# Altium schematic sheet BE200.SchDoc (part 2 of 2)
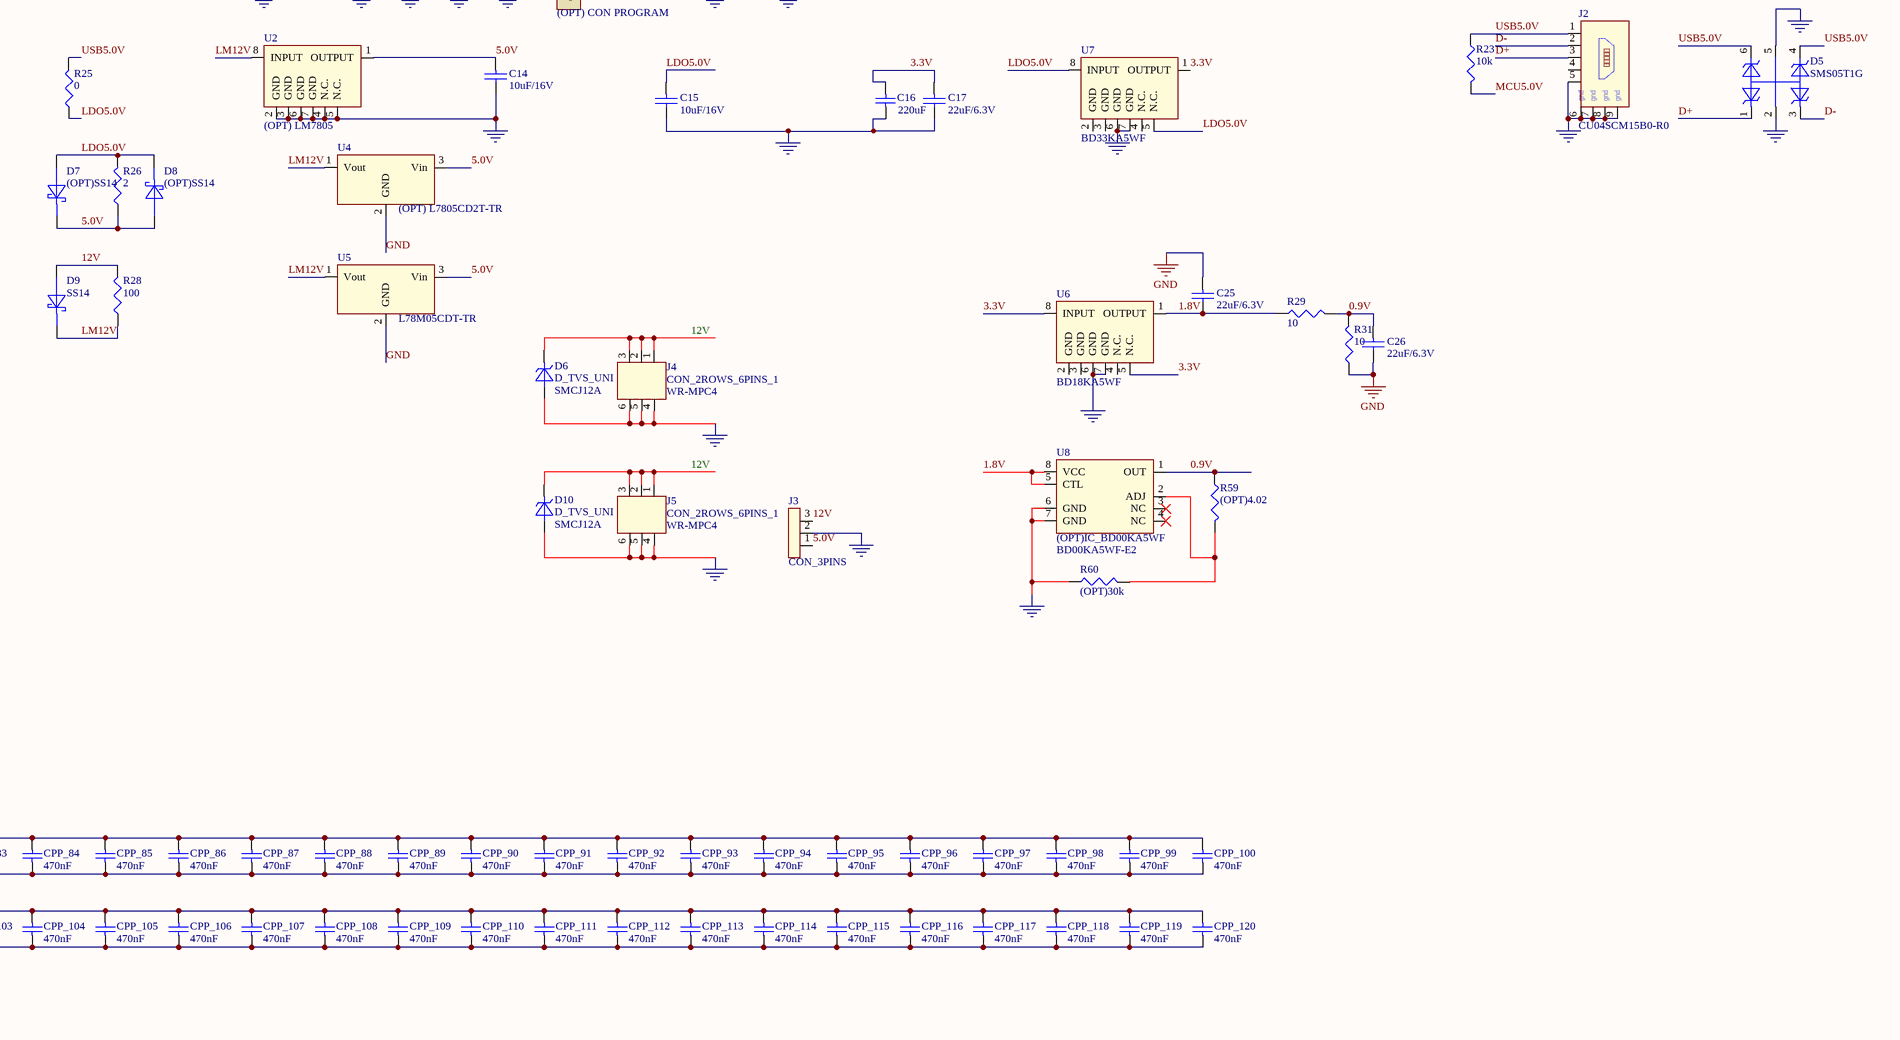
[diagram p6: BE200.SchDoc, bottom right]

## Nets
0.8V: C1_1.2 C1_2.2 C1_3.2 C1_4.2 C1_5.2 C1_6.2 C1_7.2 C1_8.2 C1_9.2 C1_10.2 C1_11.2 C1_12.2 C1_13.2 C1_14.2 C1_15.2 C1_16.2 C2_1.2 C2_2.2 C2_3.2 C2_4.2 C2_5.2 C2_6.2 C2_7.2 C2_8.2 C2_9.2 C2_10.2 C2_11.2 C2_12.2 C2_13.2 C2_14.2 C2_15.2 C2_16.2 C3_1.2 C3_2.2 C3_3.2 C3_4.2 C3_5.2 C3_6.2 C3_7.2 C3_8.2 C3_9.2 C3_10.2 C3_11.2 C3_12.2 C3_13.2 C3_14.2 C3_15.2 C3_16.2 C4_1.2 C4_2.2 C4_3.2 C4_4.2 C4_5.2 C4_6.2 C4_7.2 C4_8.2 C4_9.2 C4_10.2 C4_11.2 C4_12.2 C4_13.2 C4_14.2 C4_15.2 C4_16.2 C5_1.2 C5_2.2 C5_3.2 C5_4.2 C5_5.2 C5_6.2 C5_7.2 C5_8.2 C5_9.2 C5_10.2 C5_11.2 C5_12.2 C5_13.2 C5_14.2 C5_15.2 C5_16.2 C6_1.2 C6_2.2 C6_3.2 C6_4.2 C6_5.2 C6_6.2 C6_7.2 C6_8.2 C6_9.2 C6_10.2 C6_11.2 C6_12.2 C6_13.2 C6_14.2 C6_15.2 C6_16.2 C6P_1.1 C6P_2.1 C6P_3.1 C6P_4.1 C7_1.2 C7_2.2 C7_3.2 C7_4.2 C7_5.2 C7_6.2 C7_7.2 C7_8.2 C7_9.2 C7_10.2 C7_11.2 C7_12.2 C7_13.2 C7_14.2 C7_15.2 C7_16.2 C7P_1.1 C7P_2.1 C7P_3.1 C7P_4.1 C8_1.2 C8_2.2 C8_3.2 C8_4.2 C8_5.2 C8_6.2 C8_7.2 C8_8.2 C8_9.2 C8_10.2 C8_11.2 C8_12.2 C8_13.2 C8_14.2 C8_15.2 C8_16.2 C8P_1.1 C8P_2.1 C8P_3.1 C8P_4.1 C9_1.2 C9_2.2 C9_3.2 C9_4.2 C9_5.2 C9_6.2 C9_7.2 C9_8.2 C9_9.2 C9_10.2 C9_11.2 C9_12.2 C9_13.2 C9_14.2 C9_15.2 C9_16.2 C10_1.2 C10_2.2 C10_3.2 C10_4.2 C10_5.2 C10_6.2 C10_7.2 C10_8.2 C10_9.2 C10_10.2 C10_11.2 C10_12.2 C10_13.2 C10_14.2 C10_15.2 C10_16.2 C11_1.2 C11_2.2 C11_3.2 C11_4.2 C11_5.2 C11_6.2 C11_7.2 C11_8.2 C11_9.2 C11_10.2 C11_11.2 C11_12.2 C11_13.2 C11_14.2 C11_15.2 C11_16.2 C12_1.2 C12_2.2 C12_3.2 C12_4.2 C12_5.2 C12_6.2 C12_7.2 C12_8.2 C12_9.2 C12_10.2 C12_11.2 C12_12.2 C12_13.2 C12_14.2 C12_15.2 C12_16.2 C13_1.2 C13_2.2 C13_3.2 C13_4.2 C13_5.2 C13_6.2 C13_7.2 C13_8.2 C13_9.2 C13_10.2 C13_11.2 C13_12.2 C13_13.2 C13_14.2 C13_15.2 C13_16.2 C14_1.2 C14_2.2 C14_3.2 C14_4.2 C14_5.2 C14_6.2 C14_7.2 C14_8.2 C14_9.2 C14_10.2 C14_11.2 C14_12.2 C14_13.2 C14_14.2 C14_15.2 C14_16.2 C15_1.2 C15_2.2 C15_3.2 C15_4.2 C15_5.2 C15_6.2 C15_7.2 C15_8.2 C15_9.2 C15_10.2 C15_11.2 C15_12.2 C15_13.2 C15_14.2 C15_15.2 C15_16.2 C16_1.2 C16_2.2 C16_3.2 C16_4.2 C16_5.2 C16_6.2 C16_7.2 C16_8.2 C16_9.2 C16_10.2 C16_11.2 C16_12.2 C16_13.2 C16_14.2 C16_15.2 C16_16.2 CPP_1.2 CPP_2.2 CPP_3.2 CPP_4.2 CPP_5.2 CPP_6.2 CPP_7.2 CPP_8.2 CPP_9.2 CPP_10.2 CPP_11.2 CPP_12.2 CPP_13.2 CPP_14.2 CPP_15.2 CPP_16.2 CPP_17.2 CPP_18.2 CPP_19.2 CPP_20.2 CPP_21.2 CPP_22.2 CPP_23.2 CPP_24.2 CPP_25.2 CPP_26.2 CPP_27.2 CPP_28.2 CPP_29.2 CPP_30.2 CPP_31.2 CPP_32.2 CPP_33.2 CPP_34.2 CPP_35.2 CPP_36.2 CPP_37.2 CPP_38.2 CPP_39.2 CPP_40.2 CPP_41.2 CPP_42.2 CPP_43.2 CPP_44.2 CPP_45.2 CPP_46.2 CPP_47.2 CPP_48.2 CPP_49.2 CPP_50.2 CPP_51.2 CPP_52.2 CPP_53.2 CPP_54.2 CPP_55.2 CPP_56.2 CPP_57.2 CPP_58.2 CPP_59.2 CPP_60.2 CPP_61.2 CPP_62.2 CPP_63.2 CPP_64.2 CPP_65.2 CPP_66.2 CPP_67.2 CPP_68.2 CPP_69.2 CPP_70.2 CPP_71.2 CPP_72.2 CPP_73.2 CPP_74.2 CPP_75.2 CPP_76.2 CPP_77.2 CPP_78.2 CPP_79.2 CPP_80.2 CPP_81.2 CPP_82.2 CPP_83.2 CPP_84.2 CPP_85.2 CPP_86.2 CPP_87.2 CPP_88.2 CPP_89.2 CPP_90.2 CPP_91.2 CPP_92.2 CPP_93.2 CPP_94.2 CPP_95.2 CPP_96.2 CPP_97.2 CPP_98.2 CPP_99.2 CPP_100.2 CPP_101.2 CPP_102.2 CPP_103.2 CPP_104.2 CPP_105.2 CPP_106.2 CPP_107.2 CPP_108.2 CPP_109.2 CPP_110.2 CPP_111.2 CPP_112.2 CPP_113.2 CPP_114.2 CPP_115.2 CPP_116.2 CPP_117.2 CPP_118.2 CPP_119.2 CPP_120.2 L1P_1.2 L1P_2.2 L1P_3.2 L1P_4.2 R18.2 U1_1.1(DVDD) U1_1.2(DVDD) U1_1.3(DVDD) U1_1.4(DVDD) U1_1.14(DVDD) U1_1.15(DVDD) U1_1.16(DVDD) U1_1.17(DVDD) U1_1.18(DVDD) U1_1.19(DVDD) U1_1.20(DVDD) U1_1.21(DVDD) U1_1.22(DVDD) U1_1.23(DVDD) U1_1.24(DVDD) U1_1.26(DVDD) U1_1.27(DVDD) U1_1.28(DVDD) U1_1.29(DVDD) U1_1.30(DVDD) U1_1.31(DVDD) U1_1.32(DVDD) U1_1.33(DVDD) U1_1.34(DVDD) U1_1.35(DVDD) U1_1.36(DVDD) U1_1.45(DVDD) U1_1.46(DVDD) U1_1.47(DVDD) U1_1.48(DVDD) U1_1.49(DVDD) U1_1.50(DVDD) U1_1.51(DVDD) U1_1.52(DVDD) U1_1.53(DVDD) U1_1.54(DVDD) U1_1.55(DVDD) U1_1.57(DVDD) U1_1.58(DVDD) U1_1.59(DVDD) U1_1.60(DVDD) U1_1.61(DVDD) U1_1.62(DVDD) U1_1.63(DVDD) U1_1.64(DVDD) U1_2.1(DVDD) U1_2.2(DVDD) U1_2.3(DVDD) U1_2.4(DVDD) U1_2.14(DVDD) U1_2.15(DVDD) U1_2.16(DVDD) U1_2.17(DVDD) U1_2.18(DVDD) U1_2.19(DVDD) U1_2.20(DVDD) U1_2.21(DVDD) U1_2.22(DVDD) U1_2.23(DVDD) U1_2.24(DVDD) U1_2.26(DVDD) U1_2.27(DVDD) U1_2.28(DVDD) U1_2.29(DVDD) U1_2.30(DVDD) U1_2.31(DVDD) U1_2.32(DVDD) U1_2.33(DVDD) U1_2.34(DVDD) U1_2.35(DVDD) U1_2.36(DVDD) U1_2.45(DVDD) U1_2.46(DVDD) U1_2.47(DVDD) U1_2.48(DVDD) U1_2.49(DVDD) U1_2.50(DVDD) U1_2.51(DVDD) U1_2.52(DVDD) U1_2.53(DVDD) U1_2.54(DVDD) U1_2.55(DVDD) U1_2.57(DVDD) U1_2.58(DVDD) U1_2.59(DVDD) U1_2.60(DVDD) U1_2.61(DVDD) U1_2.62(DVDD) U1_2.63(DVDD) U1_2.64(DVDD) U1_3.1(DVDD) U1_3.2(DVDD) U1_3.3(DVDD) U1_3.4(DVDD) U1_3.14(DVDD) U1_3.15(DVDD) U1_3.16(DVDD) U1_3.17(DVDD) U1_3.18(DVDD) U1_3.19(DVDD) U1_3.20(DVDD) U1_3.21(DVDD) U1_3.22(DVDD) U1_3.23(DVDD) U1_3.24(DVDD) U1_3.26(DVDD) U1_3.27(DVDD) U1_3.28(DVDD) U1_3.29(DVDD) U1_3.30(DVDD) U1_3.31(DVDD) U1_3.32(DVDD) U1_3.33(DVDD) U1_3.34(DVDD) U1_3.35(DVDD) U1_3.36(DVDD) U1_3.45(DVDD) U1_3.46(DVDD) U1_3.47(DVDD) U1_3.48(DVDD) U1_3.49(DVDD) U1_3.50(DVDD) U1_3.51(DVDD) U1_3.52(DVDD) U1_3.53(DVDD) U1_3.54(DVDD) U1_3.55(DVDD) U1_3.57(DVDD) U1_3.58(DVDD) U1_3.59(DVDD) U1_3.60(DVDD) U1_3.61(DVDD) U1_3.62(DVDD) U1_3.63(DVDD) U1_3.64(DVDD) U1_4.1(DVDD) U1_4.2(DVDD) U1_4.3(DVDD) U1_4.4(DVDD) U1_4.14(DVDD) U1_4.15(DVDD) U1_4.16(DVDD) U1_4.17(DVDD) U1_4.18(DVDD) U1_4.19(DVDD) U1_4.20(DVDD) U1_4.21(DVDD) U1_4.22(DVDD) U1_4.23(DVDD) U1_4.24(DVDD) U1_4.26(DVDD) U1_4.27(DVDD) U1_4.28(DVDD) U1_4.29(DVDD) U1_4.30(DVDD) U1_4.31(DVDD) U1_4.32(DVDD) U1_4.33(DVDD) U1_4.34(DVDD) U1_4.35(DVDD) U1_4.36(DVDD) U1_4.45(DVDD) U1_4.46(DVDD) U1_4.47(DVDD) U1_4.48(DVDD) U1_4.49(DVDD) U1_4.50(DVDD) U1_4.51(DVDD) U1_4.52(DVDD) U1_4.53(DVDD) U1_4.54(DVDD) U1_4.55(DVDD) U1_4.57(DVDD) U1_4.58(DVDD) U1_4.59(DVDD) U1_4.60(DVDD) U1_4.61(DVDD) U1_4.62(DVDD) U1_4.63(DVDD) U1_4.64(DVDD) U1_5.1(DVDD) U1_5.2(DVDD) U1_5.3(DVDD) U1_5.4(DVDD) U1_5.14(DVDD) U1_5.15(DVDD) U1_5.16(DVDD) U1_5.17(DVDD) U1_5.18(DVDD) U1_5.19(DVDD) U1_5.20(DVDD) U1_5.21(DVDD) U1_5.22(DVDD) U1_5.23(DVDD) U1_5.24(DVDD) U1_5.26(DVDD) U1_5.27(DVDD) U1_5.28(DVDD) U1_5.29(DVDD) U1_5.30(DVDD) U1_5.31(DVDD) U1_5.32(DVDD) U1_5.33(DVDD) U1_5.34(DVDD) U1_5.35(DVDD) U1_5.36(DVDD) U1_5.45(DVDD) U1_5.46(DVDD) U1_5.47(DVDD) U1_5.48(DVDD) U1_5.49(DVDD) U1_5.50(DVDD) U1_5.51(DVDD) U1_5.52(DVDD) U1_5.53(DVDD) U1_5.54(DVDD) U1_5.55(DVDD) U1_5.57(DVDD) U1_5.58(DVDD) U1_5.59(DVDD) U1_5.60(DVDD) U1_5.61(DVDD) U1_5.62(DVDD) U1_5.63(DVDD) U1_5.64(DVDD) U1_6.1(DVDD) U1_6.2(DVDD) U1_6.3(DVDD) U1_6.4(DVDD) U1_6.14(DVDD) U1_6.15(DVDD) U1_6.16(DVDD) U1_6.17(DVDD) U1_6.18(DVDD) U1_6.19(DVDD) U1_6.20(DVDD) U1_6.21(DVDD) U1_6.22(DVDD) U1_6.23(DVDD) U1_6.24(DVDD) U1_6.26(DVDD) U1_6.27(DVDD) U1_6.28(DVDD) U1_6.29(DVDD) U1_6.30(DVDD) U1_6.31(DVDD) U1_6.32(DVDD) U1_6.33(DVDD) U1_6.34(DVDD) U1_6.35(DVDD) U1_6.36(DVDD) U1_6.45(DVDD) U1_6.46(DVDD) U1_6.47(DVDD) U1_6.48(DVDD) U1_6.49(DVDD) U1_6.50(DVDD) U1_6.51(DVDD) U1_6.52(DVDD) U1_6.53(DVDD) U1_6.54(DVDD) U1_6.55(DVDD) U1_6.57(DVDD) U1_6.58(DVDD) U1_6.59(DVDD) U1_6.60(DVDD) U1_6.61(DVDD) U1_6.62(DVDD) U1_6.63(DVDD) U1_6.64(DVDD) U1_7.1(DVDD) U1_7.2(DVDD) U1_7.3(DVDD) U1_7.4(DVDD) U1_7.14(DVDD) U1_7.15(DVDD) U1_7.16(DVDD) U1_7.17(DVDD) U1_7.18(DVDD) U1_7.19(DVDD) U1_7.20(DVDD) U1_7.21(DVDD) U1_7.22(DVDD) U1_7.23(DVDD) U1_7.24(DVDD) U1_7.26(DVDD) U1_7.27(DVDD) U1_7.28(DVDD) U1_7.29(DVDD) U1_7.30(DVDD) U1_7.31(DVDD) U1_7.32(DVDD) U1_7.33(DVDD) U1_7.34(DVDD) U1_7.35(DVDD) U1_7.36(DVDD) U1_7.45(DVDD) U1_7.46(DVDD) U1_7.47(DVDD) U1_7.48(DVDD) U1_7.49(DVDD) U1_7.50(DVDD) U1_7.51(DVDD) U1_7.52(DVDD) U1_7.53(DVDD) U1_7.54(DVDD) U1_7.55(DVDD) U1_7.57(DVDD) U1_7.58(DVDD) U1_7.59(DVDD) U1_7.60(DVDD) U1_7.61(DVDD) U1_7.62(DVDD) U1_7.63(DVDD) U1_7.64(DVDD) U1_8.1(DVDD) U1_8.2(DVDD) U1_8.3(DVDD) U1_8.4(DVDD) U1_8.14(DVDD) U1_8.15(DVDD) U1_8.16(DVDD) U1_8.17(DVDD) U1_8.18(DVDD) U1_8.19(DVDD) U1_8.20(DVDD) U1_8.21(DVDD) U1_8.22(DVDD) U1_8.23(DVDD) U1_8.24(DVDD) U1_8.26(DVDD) U1_8.27(DVDD) U1_8.28(DVDD) U1_8.29(DVDD) U1_8.30(DVDD) U1_8.31(DVDD) U1_8.32(DVDD) U1_8.33(DVDD) U1_8.34(DVDD) U1_8.35(DVDD) U1_8.36(DVDD) U1_8.45(DVDD) U1_8.46(DVDD) U1_8.47(DVDD) U1_8.48(DVDD) U1_8.49(DVDD) U1_8.50(DVDD) U1_8.51(DVDD) U1_8.52(DVDD) U1_8.53(DVDD) U1_8.54(DVDD) U1_8.55(DVDD) U1_8.57(DVDD) U1_8.58(DVDD) U1_8.59(DVDD) U1_8.60(DVDD) U1_8.61(DVDD) U1_8.62(DVDD) U1_8.63(DVDD) U1_8.64(DVDD) U1_9.1(DVDD) U1_9.2(DVDD) U1_9.3(DVDD) U1_9.4(DVDD) U1_9.14(DVDD) U1_9.15(DVDD) U1_9.16(DVDD) U1_9.17(DVDD) U1_9.18(DVDD) U1_9.19(DVDD) U1_9.20(DVDD) U1_9.21(DVDD) U1_9.22(DVDD) U1_9.23(DVDD) U1_9.24(DVDD) U1_9.26(DVDD) U1_9.27(DVDD) U1_9.28(DVDD) U1_9.29(DVDD) U1_9.30(DVDD) U1_9.31(DVDD) U1_9.32(DVDD) U1_9.33(DVDD) U1_9.34(DVDD) U1_9.35(DVDD) U1_9.36(DVDD) U1_9.45(DVDD) U1_9.46(DVDD) U1_9.47(DVDD) U1_9.48(DVDD) U1_9.49(DVDD) U1_9.50(DVDD) U1_9.51(DVDD) U1_9.52(DVDD) U1_9.53(DVDD) U1_9.54(DVDD) U1_9.55(DVDD) U1_9.57(DVDD) U1_9.58(DVDD) U1_9.59(DVDD) U1_9.60(DVDD) U1_9.61(DVDD) U1_9.62(DVDD) U1_9.63(DVDD) U1_9.64(DVDD) U1_10.1(DVDD) U1_10.2(DVDD) U1_10.3(DVDD) U1_10.4(DVDD) U1_10.14(DVDD) U1_10.15(DVDD) U1_10.16(DVDD) U1_10.17(DVDD) U1_10.18(DVDD) U1_10.19(DVDD) U1_10.20(DVDD) U1_10.21(DVDD) U1_10.22(DVDD) U1_10.23(DVDD) U1_10.24(DVDD) U1_10.26(DVDD) U1_10.27(DVDD) U1_10.28(DVDD) U1_10.29(DVDD) U1_10.30(DVDD) U1_10.31(DVDD) U1_10.32(DVDD) U1_10.33(DVDD) U1_10.34(DVDD) U1_10.35(DVDD) U1_10.36(DVDD) U1_10.45(DVDD) U1_10.46(DVDD) U1_10.47(DVDD) U1_10.48(DVDD) U1_10.49(DVDD) U1_10.50(DVDD) U1_10.51(DVDD) U1_10.52(DVDD) U1_10.53(DVDD) U1_10.54(DVDD) U1_10.55(DVDD) U1_10.57(DVDD) U1_10.58(DVDD) U1_10.59(DVDD) U1_10.60(DVDD) U1_10.61(DVDD) U1_10.62(DVDD) U1_10.63(DVDD) U1_10.64(DVDD) U1_11.1(DVDD) U1_11.2(DVDD) U1_11.3(DVDD) U1_11.4(DVDD) U1_11.14(DVDD) U1_11.15(DVDD) U1_11.16(DVDD) U1_11.17(DVDD) U1_11.18(DVDD) U1_11.19(DVDD) U1_11.20(DVDD) U1_11.21(DVDD) U1_11.22(DVDD) U1_11.23(DVDD) U1_11.24(DVDD) U1_11.26(DVDD) U1_11.27(DVDD) U1_11.28(DVDD) U1_11.29(DVDD) U1_11.30(DVDD) U1_11.31(DVDD) U1_11.32(DVDD) U1_11.33(DVDD) U1_11.34(DVDD) U1_11.35(DVDD) U1_11.36(DVDD) U1_11.45(DVDD) U1_11.46(DVDD) U1_11.47(DVDD) U1_11.48(DVDD) U1_11.49(DVDD) U1_11.50(DVDD) U1_11.51(DVDD) U1_11.52(DVDD) U1_11.53(DVDD) U1_11.54(DVDD) U1_11.55(DVDD) U1_11.57(DVDD) U1_11.58(DVDD) U1_11.59(DVDD) U1_11.60(DVDD) U1_11.61(DVDD) U1_11.62(DVDD) U1_11.63(DVDD) U1_11.64(DVDD) U1_12.1(DVDD) U1_12.2(DVDD) U1_12.3(DVDD) U1_12.4(DVDD) U1_12.14(DVDD) U1_12.15(DVDD) U1_12.16(DVDD) U1_12.17(DVDD) U1_12.18(DVDD) U1_12.19(DVDD) U1_12.20(DVDD) U1_12.21(DVDD) U1_12.22(DVDD) U1_12.23(DVDD) U1_12.24(DVDD) U1_12.26(DVDD) U1_12.27(DVDD) U1_12.28(DVDD) U1_12.29(DVDD) U1_12.30(DVDD) U1_12.31(DVDD) U1_12.32(DVDD) U1_12.33(DVDD) U1_12.34(DVDD) U1_12.35(DVDD) U1_12.36(DVDD) U1_12.45(DVDD) U1_12.46(DVDD) U1_12.47(DVDD) U1_12.48(DVDD) U1_12.49(DVDD) U1_12.50(DVDD) U1_12.51(DVDD) U1_12.52(DVDD) U1_12.53(DVDD) U1_12.54(DVDD) U1_12.55(DVDD) U1_12.57(DVDD) U1_12.58(DVDD) U1_12.59(DVDD) U1_12.60(DVDD) U1_12.61(DVDD) U1_12.62(DVDD) U1_12.63(DVDD) U1_12.64(DVDD) U1_13.1(DVDD) U1_13.2(DVDD) U1_13.3(DVDD) U1_13.4(DVDD) U1_13.14(DVDD) U1_13.15(DVDD) U1_13.16(DVDD) U1_13.17(DVDD) U1_13.18(DVDD) U1_13.19(DVDD) U1_13.20(DVDD) U1_13.21(DVDD) U1_13.22(DVDD) U1_13.23(DVDD) U1_13.24(DVDD) U1_13.26(DVDD) U1_13.27(DVDD) U1_13.28(DVDD) U1_13.29(DVDD) U1_13.30(DVDD) U1_13.31(DVDD) U1_13.32(DVDD) U1_13.33(DVDD) U1_13.34(DVDD) U1_13.35(DVDD) U1_13.36(DVDD) U1_13.45(DVDD) U1_13.46(DVDD) U1_13.47(DVDD) U1_13.48(DVDD) U1_13.49(DVDD) U1_13.50(DVDD) U1_13.51(DVDD) U1_13.52(DVDD) U1_13.53(DVDD) U1_13.54(DVDD) U1_13.55(DVDD) U1_13.57(DVDD) U1_13.58(DVDD) U1_13.59(DVDD) U1_13.60(DVDD) U1_13.61(DVDD) U1_13.62(DVDD) U1_13.63(DVDD) U1_13.64(DVDD) U1_14.1(DVDD) U1_14.2(DVDD) U1_14.3(DVDD) U1_14.4(DVDD) U1_14.14(DVDD) U1_14.15(DVDD) U1_14.16(DVDD) U1_14.17(DVDD) U1_14.18(DVDD) U1_14.19(DVDD) U1_14.20(DVDD) U1_14.21(DVDD) U1_14.22(DVDD) U1_14.23(DVDD) U1_14.24(DVDD) U1_14.26(DVDD) U1_14.27(DVDD) U1_14.28(DVDD) U1_14.29(DVDD) U1_14.30(DVDD) U1_14.31(DVDD) U1_14.32(DVDD) U1_14.33(DVDD) U1_14.34(DVDD) U1_14.35(DVDD) U1_14.36(DVDD) U1_14.45(DVDD) U1_14.46(DVDD) U1_14.47(DVDD) U1_14.48(DVDD) U1_14.49(DVDD) U1_14.50(DVDD) U1_14.51(DVDD) U1_14.52(DVDD) U1_14.53(DVDD) U1_14.54(DVDD) U1_14.55(DVDD) U1_14.57(DVDD) U1_14.58(DVDD) U1_14.59(DVDD) U1_14.60(DVDD) U1_14.61(DVDD) U1_14.62(DVDD) U1_14.63(DVDD) U1_14.64(DVDD) U1_15.1(DVDD) U1_15.2(DVDD) U1_15.3(DVDD) U1_15.4(DVDD) U1_15.14(DVDD) U1_15.15(DVDD) U1_15.16(DVDD) U1_15.17(DVDD) U1_15.18(DVDD) U1_15.19(DVDD) U1_15.20(DVDD) U1_15.21(DVDD) U1_15.22(DVDD) U1_15.23(DVDD) U1_15.24(DVDD) U1_15.26(DVDD) U1_15.27(DVDD) U1_15.28(DVDD) U1_15.29(DVDD) U1_15.30(DVDD) U1_15.31(DVDD) U1_15.32(DVDD) U1_15.33(DVDD) U1_15.34(DVDD) U1_15.35(DVDD) U1_15.36(DVDD) U1_15.45(DVDD) U1_15.46(DVDD) U1_15.47(DVDD) U1_15.48(DVDD) U1_15.49(DVDD) U1_15.50(DVDD) U1_15.51(DVDD) U1_15.52(DVDD) U1_15.53(DVDD) U1_15.54(DVDD) U1_15.55(DVDD) U1_15.57(DVDD) U1_15.58(DVDD) U1_15.59(DVDD) U1_15.60(DVDD) U1_15.61(DVDD) U1_15.62(DVDD) U1_15.63(DVDD) U1_15.64(DVDD) U1_16.1(DVDD) U1_16.2(DVDD) U1_16.3(DVDD) U1_16.4(DVDD) U1_16.14(DVDD) U1_16.15(DVDD) U1_16.16(DVDD) U1_16.17(DVDD) U1_16.18(DVDD) U1_16.19(DVDD) U1_16.20(DVDD) U1_16.21(DVDD) U1_16.22(DVDD) U1_16.23(DVDD) U1_16.24(DVDD) U1_16.26(DVDD) U1_16.27(DVDD) U1_16.28(DVDD) U1_16.29(DVDD) U1_16.30(DVDD) U1_16.31(DVDD) U1_16.32(DVDD) U1_16.33(DVDD) U1_16.34(DVDD) U1_16.35(DVDD) U1_16.36(DVDD) U1_16.45(DVDD) U1_16.46(DVDD) U1_16.47(DVDD) U1_16.48(DVDD) U1_16.49(DVDD) U1_16.50(DVDD) U1_16.51(DVDD) U1_16.52(DVDD) U1_16.53(DVDD) U1_16.54(DVDD) U1_16.55(DVDD) U1_16.57(DVDD) U1_16.58(DVDD) U1_16.59(DVDD) U1_16.60(DVDD) U1_16.61(DVDD) U1_16.62(DVDD) U1_16.63(DVDD) U1_16.64(DVDD)
1.8V: C25.2 R1_1.2 R1_2.2 R1_3.2 R1_4.2 R1_5.2 R1_6.2 R1_7.2 R1_8.2 R1_9.2 R1_10.2 R1_11.2 R1_12.2 R1_13.2 R1_14.2 R1_15.2 R1_16.2 R20.2 R29.1 U1_1.5(PLLPOC18) U1_1.25(VDDIO18) U1_1.37(VDDIOPOC18) U1_1.56(VDDIO18) U1_2.5(PLLPOC18) U1_2.25(VDDIO18) U1_2.37(VDDIOPOC18) U1_2.56(VDDIO18) U1_3.5(PLLPOC18) U1_3.25(VDDIO18) U1_3.37(VDDIOPOC18) U1_3.56(VDDIO18) U1_4.5(PLLPOC18) U1_4.25(VDDIO18) U1_4.37(VDDIOPOC18) U1_4.56(VDDIO18) U1_5.5(PLLPOC18) U1_5.25(VDDIO18) U1_5.37(VDDIOPOC18) U1_5.56(VDDIO18) U1_6.5(PLLPOC18) U1_6.25(VDDIO18) U1_6.37(VDDIOPOC18) U1_6.56(VDDIO18) U1_7.5(PLLPOC18) U1_7.25(VDDIO18) U1_7.37(VDDIOPOC18) U1_7.56(VDDIO18) U1_8.5(PLLPOC18) U1_8.25(VDDIO18) U1_8.37(VDDIOPOC18) U1_8.56(VDDIO18) U1_9.5(PLLPOC18) U1_9.25(VDDIO18) U1_9.37(VDDIOPOC18) U1_9.56(VDDIO18) U1_10.5(PLLPOC18) U1_10.25(VDDIO18) U1_10.37(VDDIOPOC18) U1_10.56(VDDIO18) U1_11.5(PLLPOC18) U1_11.25(VDDIO18) U1_11.37(VDDIOPOC18) U1_11.56(VDDIO18) U1_12.5(PLLPOC18) U1_12.25(VDDIO18) U1_12.37(VDDIOPOC18) U1_12.56(VDDIO18) U1_13.5(PLLPOC18) U1_13.25(VDDIO18) U1_13.37(VDDIOPOC18) U1_13.56(VDDIO18) U1_14.5(PLLPOC18) U1_14.25(VDDIO18) U1_14.37(VDDIOPOC18) U1_14.56(VDDIO18) U1_15.5(PLLPOC18) U1_15.25(VDDIO18) U1_15.37(VDDIOPOC18) U1_15.56(VDDIO18) U1_16.5(PLLPOC18) U1_16.25(VDDIO18) U1_16.37(VDDIOPOC18) U1_16.56(VDDIO18) U6.1(OUTPUT) U8.5(CTL) U8.8(VCC)
GND: C1.2 C1_1.1 C1_2.1 C1_3.1 C1_4.1 C1_5.1 C1_6.1 C1_7.1 C1_8.1 C1_9.1 C1_10.1 C1_11.1 C1_12.1 C1_13.1 C1_14.1 C1_15.1 C1_16.1 C1P_1.1 C1P_2.1 C1P_3.1 C1P_4.1 C2.2 C2_1.1 C2_2.1 C2_3.1 C2_4.1 C2_5.1 C2_6.1 C2_7.1 C2_8.1 C2_9.1 C2_10.1 C2_11.1 C2_12.1 C2_13.1 C2_14.1 C2_15.1 C2_16.1 C2P_1.2 C2P_2.2 C2P_3.2 C2P_4.2 C3.2 C3_1.1 C3_2.1 C3_3.1 C3_4.1 C3_5.1 C3_6.1 C3_7.1 C3_8.1 C3_9.1 C3_10.1 C3_11.1 C3_12.1 C3_13.1 C3_14.1 C3_15.1 C3_16.1 C4.2 C4_1.1 C4_2.1 C4_3.1 C4_4.1 C4_5.1 C4_6.1 C4_7.1 C4_8.1 C4_9.1 C4_10.1 C4_11.1 C4_12.1 C4_13.1 C4_14.1 C4_15.1 C4_16.1 C4P_1.2 C4P_2.2 C4P_3.2 C4P_4.2 C5_1.1 C5_2.1 C5_3.1 C5_4.1 C5_5.1 C5_6.1 C5_7.1 C5_8.1 C5_9.1 C5_10.1 C5_11.1 C5_12.1 C5_13.1 C5_14.1 C5_15.1 C5_16.1 C5P_1.2 C5P_2.2 C5P_3.2 C5P_4.2 C6_1.1 C6_2.1 C6_3.1 C6_4.1 C6_5.1 C6_6.1 C6_7.1 C6_8.1 C6_9.1 C6_10.1 C6_11.1 C6_12.1 C6_13.1 C6_14.1 C6_15.1 C6_16.1 C6P_1.2 C6P_2.2 C6P_3.2 C6P_4.2 C7.2 C7_1.1 C7_2.1 C7_3.1 C7_4.1 C7_5.1 C7_6.1 C7_7.1 C7_8.1 C7_9.1 C7_10.1 C7_11.1 C7_12.1 C7_13.1 C7_14.1 C7_15.1 C7_16.1 C7P_1.2 C7P_2.2 C7P_3.2 C7P_4.2 C8.2 C8_1.1 C8_2.1 C8_3.1 C8_4.1 C8_5.1 C8_6.1 C8_7.1 C8_8.1 C8_9.1 C8_10.1 C8_11.1 C8_12.1 C8_13.1 C8_14.1 C8_15.1 C8_16.1 C8P_1.2 C8P_2.2 C8P_3.2 C8P_4.2 C9.2 C9_1.1 C9_2.1 C9_3.1 C9_4.1 C9_5.1 C9_6.1 C9_7.1 C9_8.1 C9_9.1 C9_10.1 C9_11.1 C9_12.1 C9_13.1 C9_14.1 C9_15.1 C9_16.1 C10.2 C10_1.1 C10_2.1 C10_3.1 C10_4.1 C10_5.1 C10_6.1 C10_7.1 C10_8.1 C10_9.1 C10_10.1 C10_11.1 C10_12.1 C10_13.1 C10_14.1 C10_15.1 C10_16.1 C11.2 C11_1.1 C11_2.1 C11_3.1 C11_4.1 C11_5.1 C11_6.1 C11_7.1 C11_8.1 C11_9.1 C11_10.1 C11_11.1 C11_12.1 C11_13.1 C11_14.1 C11_15.1 C11_16.1 C12.2 C12_1.1 C12_2.1 C12_3.1 C12_4.1 C12_5.1 C12_6.1 C12_7.1 C12_8.1 C12_9.1 C12_10.1 C12_11.1 C12_12.1 C12_13.1 C12_14.1 C12_15.1 C12_16.1 C13.2 C13_1.1 C13_2.1 C13_3.1 C13_4.1 C13_5.1 C13_6.1 C13_7.1 C13_8.1 C13_9.1 C13_10.1 C13_11.1 C13_12.1 C13_13.1 C13_14.1 C13_15.1 C13_16.1 C14.2 C14_1.1 C14_2.1 C14_3.1 C14_4.1 C14_5.1 C14_6.1 C14_7.1 C14_8.1 C14_9.1 C14_10.1 C14_11.1 C14_12.1 C14_13.1 C14_14.1 C14_15.1 C14_16.1 C15.2 C15_1.1 C15_2.1 C15_3.1 C15_4.1 C15_5.1 C15_6.1 C15_7.1 C15_8.1 C15_9.1 C15_10.1 C15_11.1 C15_12.1 C15_13.1 C15_14.1 C15_15.1 C15_16.1 C16.2 C16_1.1 C16_2.1 C16_3.1 C16_4.1 C16_5.1 C16_6.1 C16_7.1 C16_8.1 C16_9.1 C16_10.1 C16_11.1 C16_12.1 C16_13.1 C16_14.1 C16_15.1 C16_16.1 C17.2 C25.1 C26.2 CPP_1.1 CPP_2.1 CPP_3.1 CPP_4.1 CPP_5.1 CPP_6.1 CPP_7.1 CPP_8.1 CPP_9.1 CPP_10.1 CPP_11.1 CPP_12.1 CPP_13.1 CPP_14.1 CPP_15.1 CPP_16.1 CPP_17.1 CPP_18.1 CPP_19.1 CPP_20.1 CPP_21.1 CPP_22.1 CPP_23.1 CPP_24.1 CPP_25.1 CPP_26.1 CPP_27.1 CPP_28.1 CPP_29.1 CPP_30.1 CPP_31.1 CPP_32.1 CPP_33.1 CPP_34.1 CPP_35.1 CPP_36.1 CPP_37.1 CPP_38.1 CPP_39.1 CPP_40.1 CPP_41.1 CPP_42.1 CPP_43.1 CPP_44.1 CPP_45.1 CPP_46.1 CPP_47.1 CPP_48.1 CPP_49.1 CPP_50.1 CPP_51.1 CPP_52.1 CPP_53.1 CPP_54.1 CPP_55.1 CPP_56.1 CPP_57.1 CPP_58.1 CPP_59.1 CPP_60.1 CPP_61.1 CPP_62.1 CPP_63.1 CPP_64.1 CPP_65.1 CPP_66.1 CPP_67.1 CPP_68.1 CPP_69.1 CPP_70.1 CPP_71.1 CPP_72.1 CPP_73.1 CPP_74.1 CPP_75.1 CPP_76.1 CPP_77.1 CPP_78.1 CPP_79.1 CPP_80.1 CPP_81.1 CPP_82.1 CPP_83.1 CPP_84.1 CPP_85.1 CPP_86.1 CPP_87.1 CPP_88.1 CPP_89.1 CPP_90.1 CPP_91.1 CPP_92.1 CPP_93.1 CPP_94.1 CPP_95.1 CPP_96.1 CPP_97.1 CPP_98.1 CPP_99.1 CPP_100.1 CPP_101.1 CPP_102.1 CPP_103.1 CPP_104.1 CPP_105.1 CPP_106.1 CPP_107.1 CPP_108.1 CPP_109.1 CPP_110.1 CPP_111.1 CPP_112.1 CPP_113.1 CPP_114.1 CPP_115.1 CPP_116.1 CPP_117.1 CPP_118.1 CPP_119.1 CPP_120.1 D1.1(C) D2.1(C) D3.1(C) D4.1(C) D5.2(AAAA) D5.5(C4) D6.2(A) D10.2(A) J1.3 J2.5 J2.6 J2.7 J2.8 J2.9 J3.2 J4.4 J4.5 J4.6 J5.4 J5.5 J5.6 Q1.2(E) Q2.2(E) Q2P_1.1(S) Q2P_1.2(S) Q2P_1.3(S) Q2P_2.1(S) Q2P_2.2(S) Q2P_2.3(S) Q2P_3.1(S) Q2P_3.2(S) Q2P_3.3(S) Q2P_4.1(S) Q2P_4.2(S) Q2P_4.3(S) Q3P_1.1(S) Q3P_1.2(S) Q3P_1.3(S) Q3P_2.1(S) Q3P_2.2(S) Q3P_2.3(S) Q3P_3.1(S) Q3P_3.2(S) Q3P_3.3(S) Q3P_4.1(S) Q3P_4.2(S) Q3P_4.3(S) R4.1 R6.1 R8.2 R9.2 R10.2 R11.2 R12.1 R13.1 R16.1 R17.1 R27.1 R31.1 R32.1 R34.1 R36.1 R38.1 R40.1 R42.1 R44.1 R46.1 R48.1 R50.1 R52.1 R54.1 R56.1 R58.1 R60.1 R62.1 R64.1 R66.1 U1.9(VSS) U1.20(AVSS) U1.25(VSS) U1.41(VSS) U1_1.7(PLLAHVSS) U1_1.9(PLLDVSS) U1_1.11(PLLVSS3) U1_1.65(EP) U1_2.7(PLLAHVSS) U1_2.9(PLLDVSS) U1_2.11(PLLVSS3) U1_2.65(EP) U1_3.7(PLLAHVSS) U1_3.9(PLLDVSS) U1_3.11(PLLVSS3) U1_3.65(EP) U1_4.7(PLLAHVSS) U1_4.9(PLLDVSS) U1_4.11(PLLVSS3) U1_4.65(EP) U1_5.7(PLLAHVSS) U1_5.9(PLLDVSS) U1_5.11(PLLVSS3) U1_5.65(EP) U1_6.7(PLLAHVSS) U1_6.9(PLLDVSS) U1_6.11(PLLVSS3) U1_6.65(EP) U1_7.7(PLLAHVSS) U1_7.9(PLLDVSS) U1_7.11(PLLVSS3) U1_7.65(EP) U1_8.7(PLLAHVSS) U1_8.9(PLLDVSS) U1_8.11(PLLVSS3) U1_8.65(EP) U1_9.7(PLLAHVSS) U1_9.9(PLLDVSS) U1_9.11(PLLVSS3) U1_9.65(EP) U1_10.7(PLLAHVSS) U1_10.9(PLLDVSS) U1_10.11(PLLVSS3) U1_10.65(EP) U1_11.7(PLLAHVSS) U1_11.9(PLLDVSS) U1_11.11(PLLVSS3) U1_11.65(EP) U1_12.7(PLLAHVSS) U1_12.9(PLLDVSS) U1_12.11(PLLVSS3) U1_12.65(EP) U1_13.7(PLLAHVSS) U1_13.9(PLLDVSS) U1_13.11(PLLVSS3) U1_13.65(EP) U1_14.7(PLLAHVSS) U1_14.9(PLLDVSS) U1_14.11(PLLVSS3) U1_14.65(EP) U1_15.7(PLLAHVSS) U1_15.9(PLLDVSS) U1_15.11(PLLVSS3) U1_15.65(EP) U1_16.7(PLLAHVSS) U1_16.9(PLLDVSS) U1_16.11(PLLVSS3) U1_16.65(EP) U1P_1.4(GND) U1P_1.9(EP) U1P_2.4(GND) U1P_2.9(EP) U1P_3.4(GND) U1P_3.9(EP) U1P_4.4(GND) U1P_4.9(EP) U2.2(GND) U2.3(GND) U2.4(N.C.) U2.5(N.C.) U2.6(GND) U2.7(GND) U4.2(GND) U5.2(GND) U6.6(GND) U6.7(GND) U7.6(GND) U7.7(GND) U8.6(GND) U8.7(GND) YO4_1.2(GND)
0.9V: C26.1 R29.2 R31.2 R59.1 U1_1.8(PLLDVDD09) U1_1.10(PLLVDDCORE09) U1_2.8(PLLDVDD09) U1_2.10(PLLVDDCORE09) U1_3.8(PLLDVDD09) U1_3.10(PLLVDDCORE09) U1_4.8(PLLDVDD09) U1_4.10(PLLVDDCORE09) U1_5.8(PLLDVDD09) U1_5.10(PLLVDDCORE09) U1_6.8(PLLDVDD09) U1_6.10(PLLVDDCORE09) U1_7.8(PLLDVDD09) U1_7.10(PLLVDDCORE09) U1_8.8(PLLDVDD09) U1_8.10(PLLVDDCORE09) U1_9.8(PLLDVDD09) U1_9.10(PLLVDDCORE09) U1_10.8(PLLDVDD09) U1_10.10(PLLVDDCORE09) U1_11.8(PLLDVDD09) U1_11.10(PLLVDDCORE09) U1_12.8(PLLDVDD09) U1_12.10(PLLVDDCORE09) U1_13.8(PLLDVDD09) U1_13.10(PLLVDDCORE09) U1_14.8(PLLDVDD09) U1_14.10(PLLVDDCORE09) U1_15.8(PLLDVDD09) U1_15.10(PLLVDDCORE09) U1_16.8(PLLDVDD09) U1_16.10(PLLVDDCORE09) U8.1(OUT)
3.3V: C2P_1.1 C2P_2.1 C2P_3.1 C2P_4.1 C4.1 C8.1 C9.1 C10.1 C11.1 C16.1 C17.1 J1.2 R1.2 R19.2 R22.2 U1.10(VDD) U1.19(AVDD) U1.26(VDD) U1.35(VUSB3V3) U1.38(VDD) U1.57(VDD) U1P_1.6(Vlogic) U1P_2.6(Vlogic) U1P_3.6(Vlogic) U1P_4.6(Vlogic) U6.5(N.C.) U6.8(INPUT) U7.1(OUTPUT)
5.0V: C1P_1.2 C1P_2.2 C1P_3.2 C1P_4.2 C14.1 D1P_1.2(A) D1P_2.2(A) D1P_3.2(A) D1P_4.2(A) D7.1(C) D8.2(A) J3.1 R26.1 U1P_1.7(VCC) U1P_2.7(VCC) U1P_3.7(VCC) U1P_4.7(VCC) U2.1(OUTPUT) U4.3(Vin) U5.3(Vin)
12V: C4P_1.1 C4P_2.1 C4P_3.1 C4P_4.1 C5P_1.1 C5P_2.1 C5P_3.1 C5P_4.1 D6.1(C) D9.2(A) D10.1(C) J3.3 J4.1 J4.2 J4.3 J5.1 J5.2 J5.3 Q1P_1.5(D) Q1P_1.6(D) Q1P_1.7(D) Q1P_1.8(D) Q1P_2.5(D) Q1P_2.6(D) Q1P_2.7(D) Q1P_2.8(D) Q1P_3.5(D) Q1P_3.6(D) Q1P_3.7(D) Q1P_3.8(D) Q1P_4.5(D) Q1P_4.6(D) Q1P_4.7(D) Q1P_4.8(D) R15.1 R28.2
BOOT1: C3P_1.1 D1P_1.1(C) U1P_1.8(BOOT)
BOOT2: C3P_2.1 D1P_2.1(C) U1P_2.8(BOOT)
BOOT3: C3P_3.1 D1P_3.1(C) U1P_3.8(BOOT)
BOOT4: C3P_4.1 D1P_4.1(C) U1P_4.8(BOOT)
BS: R61.1 R62.2 U1_1.13(BS) U1_2.13(BS) U1_3.13(BS) U1_4.13(BS) U1_5.13(BS) U1_6.13(BS) U1_7.13(BS) U1_8.13(BS) U1_9.13(BS) U1_10.13(BS) U1_11.13(BS) U1_12.13(BS) U1_13.13(BS) U1_14.13(BS) U1_15.13(BS) U1_16.13(BS)
BS_MCU: R61.2 U1.55(C3IN1+/VCMPST3/RP71/RD7)
D+: D5.1(C1) J2.3 U1.37(D+/RG2)
D-: D5.3(C2) J2.2 U1.36(D-/RG3)
FB: C3.1 R18.1 U1.2(AN30/PWM4L/PMD6/RPI86/RE6)
GREEN: D2.2(A) U1.42(RTCC/DMLN/RPI72/RD8)
HARD_ONE: R63.1 R64.2 U1_1.44(HARD1) U1_2.44(HARD1) U1_3.44(HARD1) U1_4.44(HARD1) U1_5.44(HARD1) U1_6.44(HARD1) U1_7.44(HARD1) U1_8.44(HARD1) U1_9.44(HARD1) U1_10.44(HARD1) U1_11.44(HARD1) U1_12.44(HARD1) U1_13.44(HARD1) U1_14.44(HARD1) U1_15.44(HARD1) U1_16.44(HARD1)
HARD_ONE_MCU: R63.2 U1.54(C3IN2-/RP70/RD6)
HARD_ZERO: R65.1 R66.2 U1_1.43(HARD0) U1_2.43(HARD0) U1_3.43(HARD0) U1_4.43(HARD0) U1_5.43(HARD0) U1_6.43(HARD0) U1_7.43(HARD0) U1_8.43(HARD0) U1_9.43(HARD0) U1_10.43(HARD0) U1_11.43(HARD0) U1_12.43(HARD0) U1_13.43(HARD0) U1_14.43(HARD0) U1_15.43(HARD0) U1_16.43(HARD0)
HARD_ZERO_MCU: R65.2 U1.53(PMRD/RP69/RD5)
HO1: Q1P_1.4(G) U1P_1.1(HO)
HO2: Q1P_2.4(G) U1P_2.1(HO)
HO3: Q1P_3.4(G) U1P_3.1(HO)
HO4: Q1P_4.4(G) U1P_4.1(HO)
LDO5.0V: C15.1 D7.2(A) D8.1(C) R25.1 R26.2 U7.5(N.C.) U7.8(INPUT)
LM12V: D9.1(C) R28.1 U2.8(INPUT) U4.1(Vout) U5.1(Vout)
LO1: Q2P_1.4(G) Q3P_1.4(G) U1P_1.3(LO)
LO2: Q2P_2.4(G) Q3P_2.4(G) U1P_2.3(LO)
LO3: Q2P_3.4(G) Q3P_3.4(G) U1P_3.3(LO)
LO4: Q2P_4.4(G) Q3P_4.4(G) U1P_4.3(LO)
Main OSC In: C12.1 U1.39(OSC1/RPI60/RC12) Y1.1
Main OSC Out: C13.1 U1.40(OSC2/CLKO/RC15) Y1.2
MCLR: C7.1 J1.1 R22.1 U1.7(MCLR)
MCU5.0V: R23.2 U1.34(VBUS)
MCU_CS1: R57.2 U1.16(PGED3/AN0/VREF+/RPI32/RB0)
MCU_CS2: R55.2 U1.15(PGEC3/AN1/VREF-/RPI33/RB1)
MCU_CS3: R53.2 U1.14(AN2/C2IN2-/VMIO/RPI34/RB2)
MCU_CS4: R51.2 U1.13(AN3/C2IN1+/VPIO/RPI35/RB3)
MCU_CS5: R49.2 U1.12(AN4/C1IN2-/USBOEN/RPI36/RB4)
MCU_CS6: R47.2 U1.11(AN5/C1IN1+/VBUSON/VBUSST/RPI37/RB5)
MCU_CS7: R45.2 U1.17(PGEC1/AN6/RPI38/RB6)
MCU_CS8: R43.2 U1.18(PGED1/AN7/RCV/RPI39/RB7)
MCU_CS9: R41.2 U1.21(AN8/PMA6/RPI40/RB8)
MCU_CS10: R39.2 U1.22(AN9/PMA7//RPI41/RB9)
MCU_CS11: R37.2 U1.23(TMS/AN10/CVREF/PMA13/RPI42/RB10)
MCU_CS12: R35.2 U1.24(TDO/AN11/PMA12/RPI43/RB11)
MCU_CS13: R33.2 U1.27(TCK/AN12/PMA11/RPI44/RB12)
MCU_CS14: R30.2 U1.28(TDI/AN13/PMA10/RPI45/RB13)
MCU_CS15: R24.2 U1.29(AN14/PMA1/RPI46/RB14)
MCU_CS16: R2.2 U1.30(AN15/PMA0/RPI47/RB15)
MCU_MISO0: Q1.3(C) R1.1 U1.5(C1IN1-/SDI2/PMA4/RPI119/RG7)
MCU_MOSI0: R5.2 U1.6(C2IN3-/SDO2/PMA3/RP120/RG8)
MCU_SCK0: R7.2 U1.4(C1IN3-/SCK2/PMA5/RP118/RG6)
MEAS12: C2.1 R15.2 R16.2 U1.3(AN31/PWM4H/PMD7/RP87/RE7)
ORANGE: D4.2(A) U1.45(PMCS1/RPI75/RD11)
PGC: J1.5 U1.48(PGEC2/SOSCO/C3IN1-/T1CK/RPI62/RC14)
PGD: J1.4 U1.47(PGED2/SOSCI/C3IN3-/RPI61/RC13)
PWM1H: U1.61(AN25/PWM1H/PMD1/RPI81/RE1)
PWM1L: U1.60(AN24/PWM1L/PMD0/RP80/RE0)
PWM2H: R10.1 U1.63(AN27/PWM2H/PMD3/RPI83/RE3) U1P_3.5(IN)
PWM2L: R11.1 U1.62(AN26/PWM2L/PMD2/RP82/RE2) U1P_4.5(IN)
PWM3H: R12.2 U1.1(AN29/PWM3H/PMD5/RP85/RE5) U1P_1.5(IN)
PWM3L: R9.1 U1.64(AN28/PWM3L/PMD4/RP84/RE4) U1P_2.5(IN)
RED: D1.2(A) U1.43(ASDA1/DPLN/RPI73/RD9)
RESET: R3.1 R13.2 U1_1.38(RST) U1_2.38(RST) U1_3.38(RST) U1_4.38(RST) U1_5.38(RST) U1_6.38(RST) U1_7.38(RST) U1_8.38(RST) U1_9.38(RST) U1_10.38(RST) U1_11.38(RST) U1_12.38(RST) U1_13.38(RST) U1_14.38(RST) U1_15.38(RST) U1_16.38(RST)
RESET_MCU: R3.2 U1.8(C2IN1-/PMA2/RPI121/RG9)
SPI_CS1: R57.1 R58.2 U1_1.39(SPI_CS)
SPI_CS2: R55.1 R56.2 U1_2.39(SPI_CS)
SPI_CS3: R53.1 R54.2 U1_3.39(SPI_CS)
SPI_CS4: R51.1 R52.2 U1_4.39(SPI_CS)
SPI_CS5: R49.1 R50.2 U1_5.39(SPI_CS)
SPI_CS6: R47.1 R48.2 U1_6.39(SPI_CS)
SPI_CS7: R45.1 R46.2 U1_7.39(SPI_CS)
SPI_CS8: R43.1 R44.2 U1_8.39(SPI_CS)
SPI_CS9: R41.1 R42.2 U1_9.39(SPI_CS)
SPI_CS10: R39.1 R40.2 U1_10.39(SPI_CS)
SPI_CS11: R37.1 R38.2 U1_11.39(SPI_CS)
SPI_CS12: R35.1 R36.2 U1_12.39(SPI_CS)
SPI_CS13: R33.1 R34.2 U1_13.39(SPI_CS)
SPI_CS14: R30.1 R32.2 U1_14.39(SPI_CS)
SPI_CS15: R24.1 R27.2 U1_15.39(SPI_CS)
SPI_CS16: R2.1 R4.2 U1_16.39(SPI_CS)
SPI_MISO: Q1.1(B) U1_1.41(SPI_MISO) U1_2.41(SPI_MISO) U1_3.41(SPI_MISO) U1_4.41(SPI_MISO) U1_5.41(SPI_MISO) U1_6.41(SPI_MISO) U1_7.41(SPI_MISO) U1_8.41(SPI_MISO) U1_9.41(SPI_MISO) U1_10.41(SPI_MISO) U1_11.41(SPI_MISO) U1_12.41(SPI_MISO) U1_13.41(SPI_MISO) U1_14.41(SPI_MISO) U1_15.41(SPI_MISO) U1_16.41(SPI_MISO)
SPI_MOSI: R5.1 R6.2 U1_1.42(SPI_MOSI) U1_2.42(SPI_MOSI) U1_3.42(SPI_MOSI) U1_4.42(SPI_MOSI) U1_5.42(SPI_MOSI) U1_6.42(SPI_MOSI) U1_7.42(SPI_MOSI) U1_8.42(SPI_MOSI) U1_9.42(SPI_MOSI) U1_10.42(SPI_MOSI) U1_11.42(SPI_MOSI) U1_12.42(SPI_MOSI) U1_13.42(SPI_MOSI) U1_14.42(SPI_MOSI) U1_15.42(SPI_MOSI) U1_16.42(SPI_MOSI)
SPI_SCK: R7.1 R17.2 U1_1.40(SPI_SCK) U1_2.40(SPI_SCK) U1_3.40(SPI_SCK) U1_4.40(SPI_SCK) U1_5.40(SPI_SCK) U1_6.40(SPI_SCK) U1_7.40(SPI_SCK) U1_8.40(SPI_SCK) U1_9.40(SPI_SCK) U1_10.40(SPI_SCK) U1_11.40(SPI_SCK) U1_12.40(SPI_SCK) U1_13.40(SPI_SCK) U1_14.40(SPI_SCK) U1_15.40(SPI_SCK) U1_16.40(SPI_SCK)
SWN1: C3P_1.2 L1P_1.1 Q1P_1.1(S) Q1P_1.2(S) Q1P_1.3(S) Q2P_1.5(D) Q2P_1.6(D) Q2P_1.7(D) Q2P_1.8(D) Q3P_1.5(D) Q3P_1.6(D) Q3P_1.7(D) Q3P_1.8(D) U1P_1.2(SW)
SWN2: C3P_2.2 L1P_2.1 Q1P_2.1(S) Q1P_2.2(S) Q1P_2.3(S) Q2P_2.5(D) Q2P_2.6(D) Q2P_2.7(D) Q2P_2.8(D) Q3P_2.5(D) Q3P_2.6(D) Q3P_2.7(D) Q3P_2.8(D) U1P_2.2(SW)
SWN3: C3P_3.2 L1P_3.1 Q1P_3.1(S) Q1P_3.2(S) Q1P_3.3(S) Q2P_3.5(D) Q2P_3.6(D) Q2P_3.7(D) Q2P_3.8(D) Q3P_3.5(D) Q3P_3.6(D) Q3P_3.7(D) Q3P_3.8(D) U1P_3.2(SW)
SWN4: C3P_4.2 L1P_4.1 Q1P_4.1(S) Q1P_4.2(S) Q1P_4.3(S) Q2P_4.5(D) Q2P_4.6(D) Q2P_4.7(D) Q2P_4.8(D) Q3P_4.5(D) Q3P_4.6(D) Q3P_4.7(D) Q3P_4.8(D) U1P_4.2(SW)
TPD4: U1.52(PMWR/RP68/RD4)
TPF0: U1.58(VCMPST1/RP96/RF0)
TPF1: U1.59(VCMPST2/RP97/RF1)
TPF3: U1.33(USBID/RP99/RF3)
U2Rx: U1.31(SDA2/PMA9/RP100/RF4)
U2Tx: U1.32(SCL2/PMA8/RP101/RF5)
USB5.0V: D5.4(C3) D5.6(C4) J2.1 R23.1 R25.2
VCAP: C1.1 U1.56(VCAP)
VDDOSC: R19.1 R20.1 R67.2 YO4_1.1(OE) YO4_1.4(VDD)
XCLK0: Q2.1(B) R21.1 U1.46(INT0/DMH/RP64/RD0)
XCLK1: R14.2 R21.2 U1.49(VCPCON/RP65/RD1) U1.50(DPH/RP66/RD2) U1.51(PMBE/RP67/RD3)
XCLKIN: Q2.3(C) R8.1 R14.1 R67.1 U1_1.12(OSC_CLK) U1_2.12(OSC_CLK) U1_3.12(OSC_CLK) U1_4.12(OSC_CLK) U1_5.12(OSC_CLK) U1_6.12(OSC_CLK) U1_7.12(OSC_CLK) U1_8.12(OSC_CLK) U1_9.12(OSC_CLK) U1_10.12(OSC_CLK) U1_11.12(OSC_CLK) U1_12.12(OSC_CLK) U1_13.12(OSC_CLK) U1_14.12(OSC_CLK) U1_15.12(OSC_CLK) U1_16.12(OSC_CLK) YO4_1.3(OSC)
YELLOW: D3.2(A) U1.44(ASCL1/PMCS2/RPI74/RD10)
NetR1_1_1: R1_1.1 U1_1.6(PLLAHVDD18)
NetR1_2_1: R1_2.1 U1_2.6(PLLAHVDD18)
NetR1_3_1: R1_3.1 U1_3.6(PLLAHVDD18)
NetR1_4_1: R1_4.1 U1_4.6(PLLAHVDD18)
NetR1_5_1: R1_5.1 U1_5.6(PLLAHVDD18)
NetR1_6_1: R1_6.1 U1_6.6(PLLAHVDD18)
NetR1_7_1: R1_7.1 U1_7.6(PLLAHVDD18)
NetR1_8_1: R1_8.1 U1_8.6(PLLAHVDD18)
NetR1_9_1: R1_9.1 U1_9.6(PLLAHVDD18)
NetR1_10_1: R1_10.1 U1_10.6(PLLAHVDD18)
NetR1_11_1: R1_11.1 U1_11.6(PLLAHVDD18)
NetR1_12_1: R1_12.1 U1_12.6(PLLAHVDD18)
NetR1_13_1: R1_13.1 U1_13.6(PLLAHVDD18)
NetR1_14_1: R1_14.1 U1_14.6(PLLAHVDD18)
NetR1_15_1: R1_15.1 U1_15.6(PLLAHVDD18)
NetR1_16_1: R1_16.1 U1_16.6(PLLAHVDD18)
NetR59_2: R59.2 R60.2 U8.2(ADJ)

Not connected (* = marked no-connect by the designer): J2 4; U6 2(GND) 3(GND) 4(N.C.); U7 2(GND) 3(GND) 4(N.C.); U8 3(NC)* 4(NC)*

## Notes on the sheet
- XCLK1
- (near C4) XCLK1
- Labels drawn without touching a wire or pin: GND
- (in symbol CON_USB_MINI_1) gnd

## Library data of the parts
C1 C1P_1-C1P_4 C2 C2P_1-C2P_4 C3 C3P_1-C3P_4 C4 C7-C15 C17 C25 C26 = CAP: Capacitor
  C3: Manufacturer PN: *
C1_1-C1_16 C2_1-C2_16 C3_1-C3_16 C4_1-C4_16 C5_1-C5_16 C6_1-C6_16 C7_1-C7_16 C8_1-C8_16 C9_1-C9_16 C10_1-C10_16 C11_1-C11_16 C12_1-C12_16 C13_1-C13_16 C14_1-C14_16 C15_1-C15_16 C16_1-C16_16 CPP_1-CPP_120 = Cap Semi: Capacitor (Semiconductor SIM Model); Published: 8-Jun-2000; LatestRevisionDate: 29-May-2009; LatestRevisionNote: IPC-7351 Footprint Added.; PackageReference: C1206; Publisher: Altium Limited; PackageDescription: Chip Capacitor; Value: 470nF; Manufacturer PN: *
C4P_1-C4P_4 C5P_1-C5P_4 C6P_1-C6P_4 C7P_1-C7P_4 C8P_1-C8P_4 C16 = Cap Semi: CL32A227MQVNNNE 220UF 6.3V 20% X5R 1210; Published: 8-Jun-2000; LatestRevisionDate: 29-May-2009; LatestRevisionNote: IPC-7351 Footprint Added.; PackageReference: C1206; Publisher: Altium Limited; PackageDescription: Chip Capacitor
  C4P_1-C4P_4 C5P_1-C5P_4: Value: 100uF
  C6P_1-C6P_4 C7P_1-C7P_4 C8P_1-C8P_4 C16: Value: 220uF
D1-D4 = LED_2: NOTE: <NOTE>
D1P_1-D1P_4 = DDE000001203: DB_PART_TYPE: Fast; DB_MANUFACTURER_PART: Diodes        1N4448HWT; NOTE: <NOTE>; DB_T_RANGE: -65 to 150; DB_VOLTAGE: 80V; DB_CURRENT: 125mA; DB_PACKAGE: SOD523; DB_DESCRIPTION: D 1N4448HWT SOD523; DB_APPROVED_ON: 09.10.2010 г.; DB_STATUS: NEW; DB_PART_NUMBER: DDE000001203; DB_PCB_DEVICE: SMD_SOD523_SOD1608X65N
D5 = D_TVS_QUAD_C1AA2AA5C3C4C6: 4 IO lines TVS; NOTE: <NOTE>
D6 D10 = DDE000001725: DB_PART_TYPE: TVS; DB_MANUFACTURER_PART: Diodes        SMCJ12A; NOTE: <NOTE>; DB_T_RANGE: -55 to 150; DB_VOLTAGE: 12V; DB_CURRENT: 75A(Max); DB_PACKAGE: SMC; DB_DESCRIPTION: D SMCJ12A SMC; DB_APPROVED_ON: 09.10.2010 г.; DB_STATUS: NEW; DB_PART_NUMBER: DDE000001725; DB_PCB_DEVICE: SMD_DO214AC_SMC
D7-D9 = D_STKY: NOTE: <NOTE>
J1 = CON5: Connector
J2 = CON_USB_MINI_1: NOTE: <NOTE>
J4 J5 = CON000000279: DB_PART_TYPE: Connector; DB_MANUFACTURER_PART: WE        	649 006 211 22; DB_PINS_NUMBER: 6; DB_PITCH: 4.2mm; DB_T_RANGE: -40 to 105; DB_VOLTAGE: 600VAC; DB_CURRENT: 6 - 9A; DB_PACKAGE: PTH; DB_DESCRIPTION: CONN PCB 6P M S PTH; DB_APPROVED_BY: VSN; DB_APPROVED_ON: 31.5.2014 г. 08:51:24; DB_STATUS: NEW; DB_PART_NUMBER: CON000000279; DB_PCB_DEVICE: PTH_CON_WR-MRC4-6P_S; DB_DATASHEET: http://john.epiqdesign.com/projects/CIS_Datasheets/CON_6490xx21122.pdf?rev=1438&sc=0
L1P_1-L1P_4 = L
Q1 Q2 = BJT_NPN_B1E2C3: NOTE: <NOTE>
Q1P_1-Q1P_4 Q2P_1-Q2P_4 Q3P_1-Q3P_4 = MOS_N_D1_S1S2S3G4D5D6D7D8: NOTE: <NOTE>
R1 R1_1-R1_16 R2-R67 = Res3: Resistor; Published: 8-Jun-2000; LatestRevisionDate: 29-May-2009; LatestRevisionNote: IPC-7351 Footprint Added.; PackageReference: J1-0603; Publisher: Altium Limited; PackageDescription: Chip Resistor
  R1 R2 R4 R24 R27 R30 R32-R58 R61 R63 R65: Value: 1k
  R1_1-R1_16: Value: 0; Manufacturer PN: *
  R3 R5 R7 R19 R25: Value: 0
  R6 R17 R62 R64 R66 R67: Value: (OPT)1k
  R8 R14: Value: (OPT)47
  R9-R12 R15 R22 R23: Value: 10k
  R13: Value: (OPT)470
  R16: Value: 2.4k
  R18: Value: 10k; Manufacturer PN: *
  R20 R21: Value: (OPT)0
  R26: Value: 2
  R28: Value: 100
  R29 R31: Value: 10
  R59: Value: (OPT)4.02
  R60: Value: (OPT)30k
U1P_1-U1P_4 = DRVFET_LTC4442: Mosfet 12V Dual Bootstrapped PWM Sync Buck Optimised
U2 U6 U7 = IC_LM2931AD-5.0R2G_SO-8
U4 U5 = IC_Vout1GND2Vin3: NOTE: <NOTE>
U8 = PSU000000128: DB_PART_TYPE: Linear Voltage Regulator; DB_MANUFACTURER_PART: ROHM        BD00KA5WF-E2; DB_T_RANGE: -40 to 105; DB_VOLTAGE: 3.3V; DB_CURRENT: 500mA; DB_PACKAGE: SOIC-8; DB_DESCRIPTION: IC BD00KA5WF-E2 SOIC-8; DB_PCB_DEVICE: SMD_SOIC127P620X160-8N; DB_APPROVED_BY: VSN; DB_APPROVED_ON: 07.5.2014 г. 13:19:57; DB_STATUS: NEW; DB_PART_NUMBER: PSU000000128; DB_DATASHEET: http://john.epiqdesign.com/projects/CIS_Datasheets/IC_bdxxka5wf-e-209388.pdf?rev=1408&sc=0
Y1 = CRYSTAL
YO4_1 = XTAL_OE1GND2OSC3VDD4: NOTE: <NOTE>